# EasyEDA Pro project AgOopenHardwareMicro.eprj, schematic AiO v4 Micro
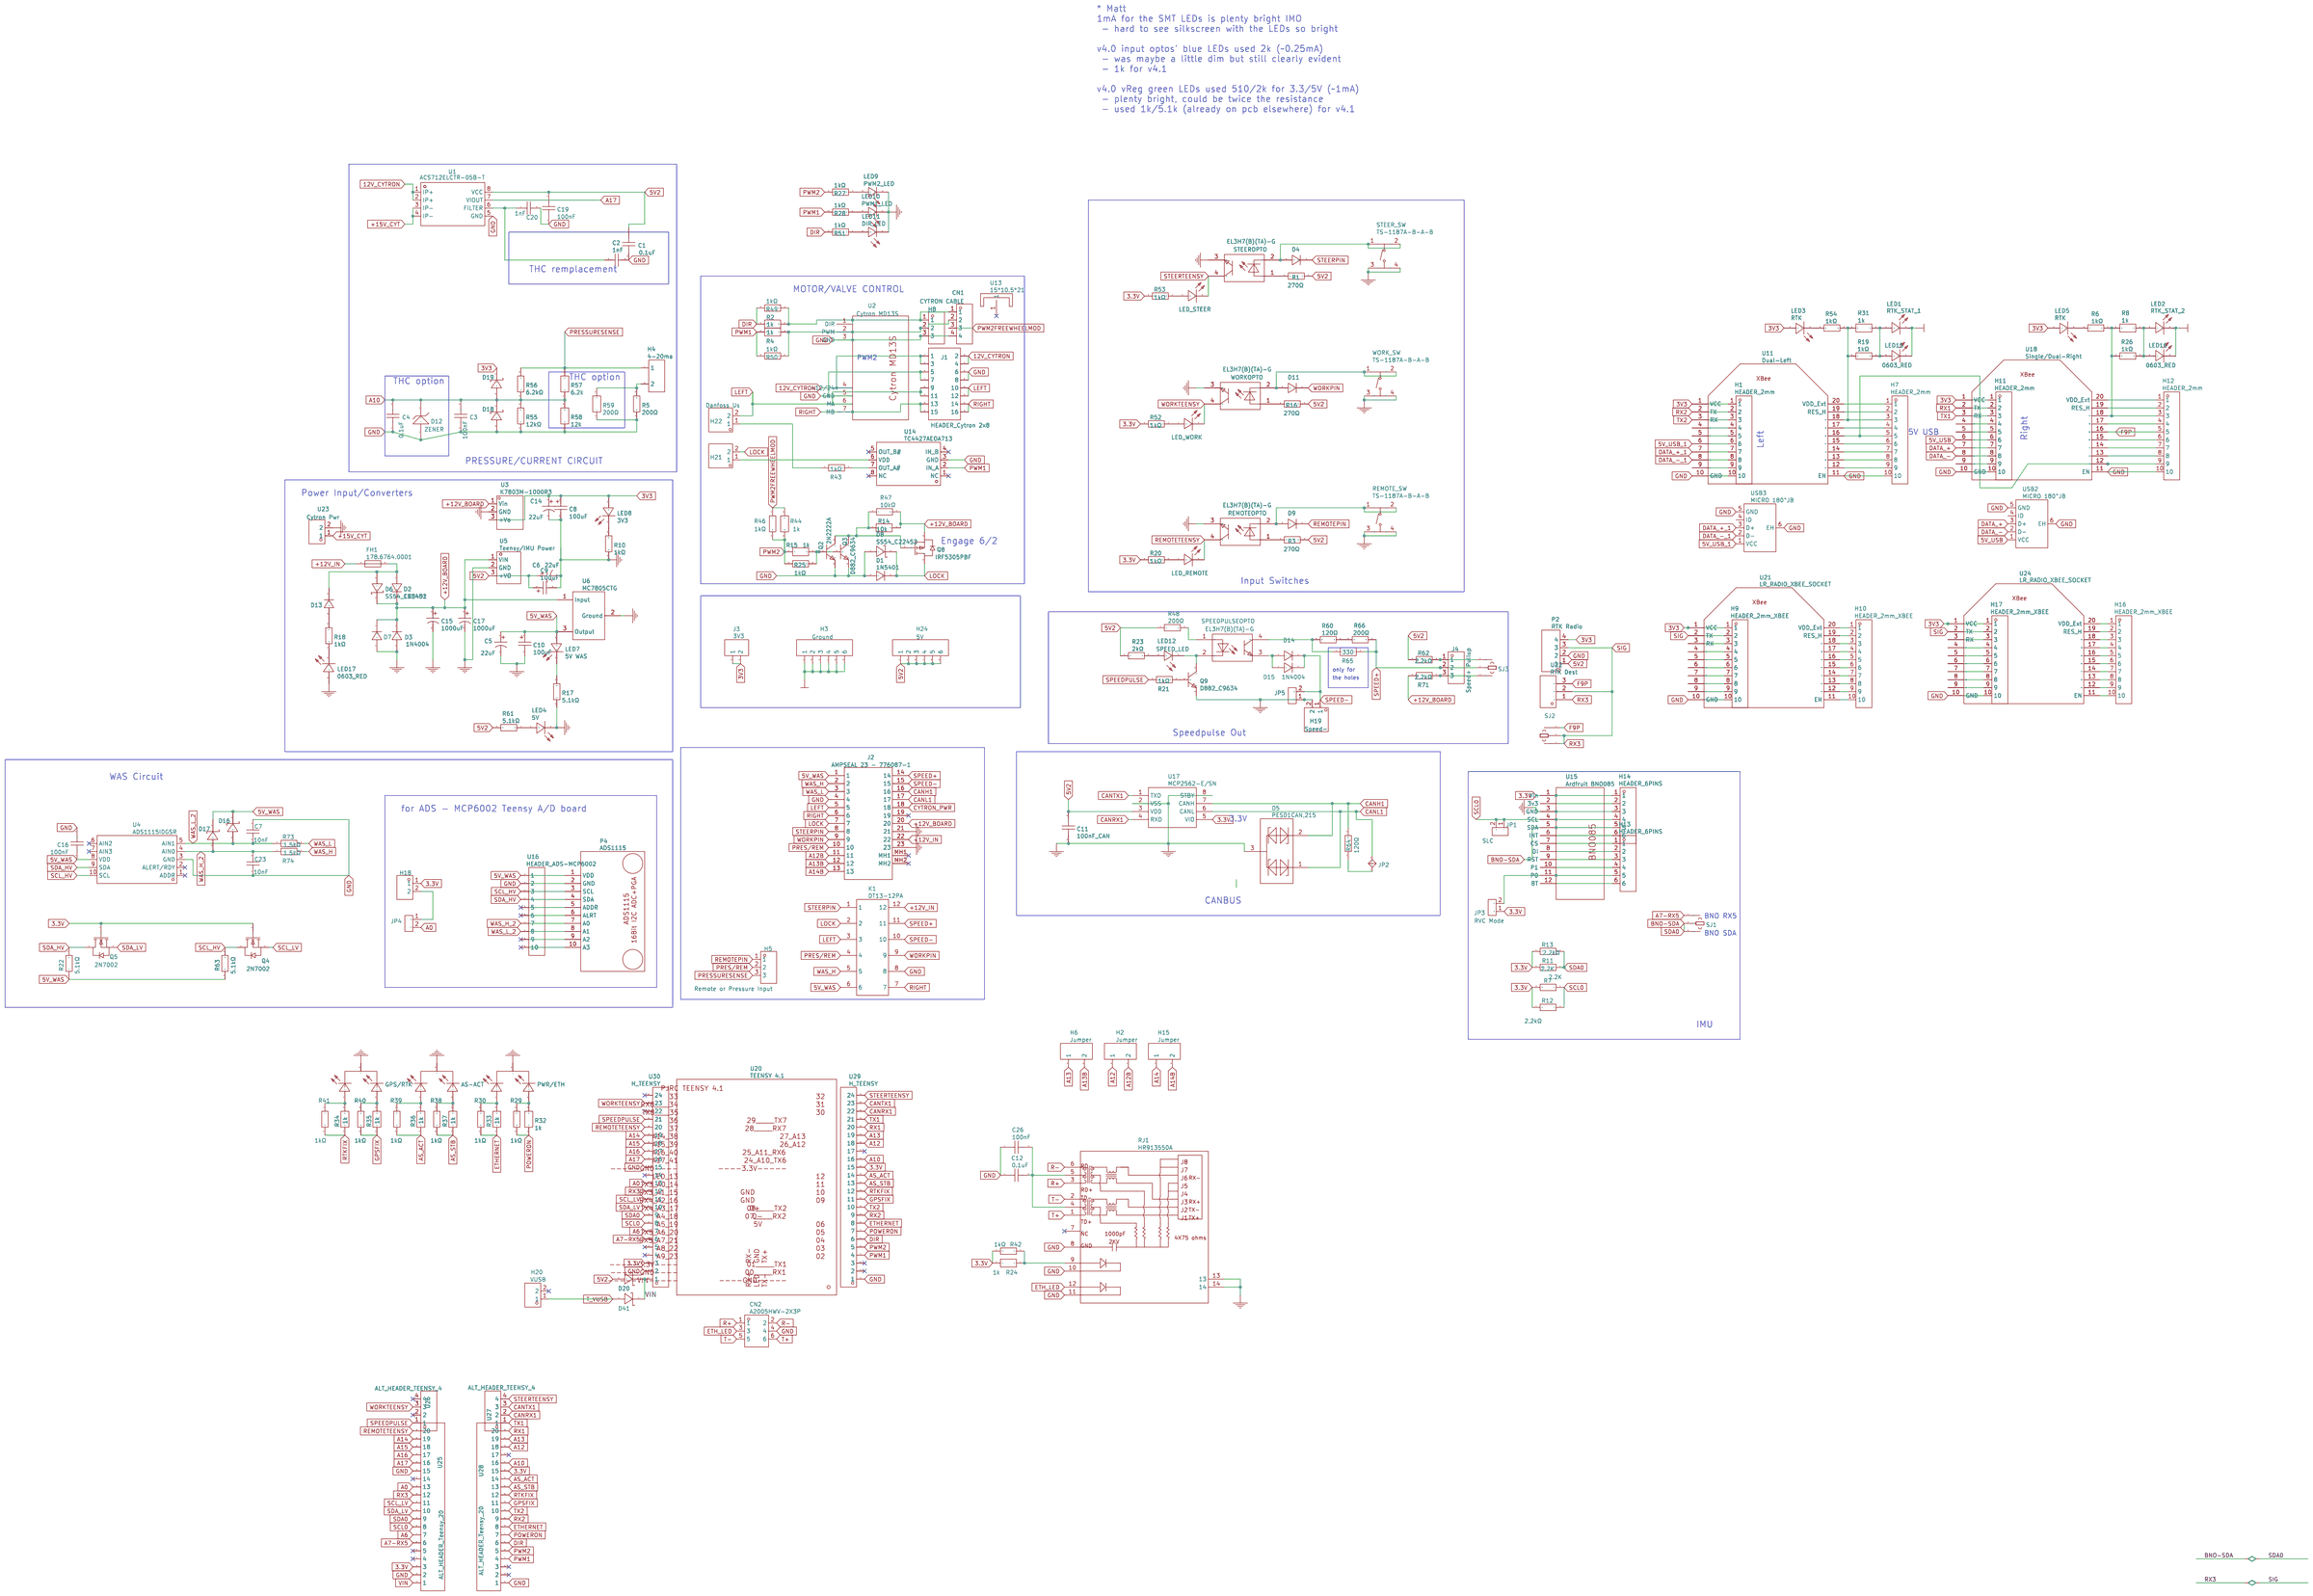
[diagram p0: schematic sheet]

## Parts
AS-ACT  DY-339URUYGW/SN  [footprint_04ce]
C1  0.1uF  [footprint_9b0b]  (no BOM)
C2  1nF  [footprint_89b2]  (no BOM)
C3  100nF  [footprint_19ac]
C4  0.1uF  [footprint_9b0b]  (no BOM)
C5  22uF  [footprint_a80e]  (no BOM)
C6  22uF  [footprint_a80e]  (no BOM)
C7  10nF  [footprint_89fb]
C8  100uF  [footprint_7bcb]
C9  100uF  [footprint_7bcb]
C10  100uF  [footprint_7bcb]
C11  100nF_CAN  [footprint_19ac]
C12  0.1uF  [footprint_9b0b]  (no BOM)
C14  22uF  [footprint_a80e]  (no BOM)
C15  1000uF  [footprint_6613]
C16  100nF  [footprint_19ac]
C17  1000uF  [footprint_6613]
C19  100nF  [footprint_19ac]
C20  1nF  [footprint_19ac]
C23  10nF  [footprint_89fb]
C26  100nF  [footprint_19ac]
CN1  CYTRON CABLE  [footprint_3aea]  (no BOM)
CN2  A2005HWV-2X3P  [footprint_9724]
D1  1N5401  [footprint_8dbb]  (no BOM)
D2  1N5401  [footprint_8dbb]  (no BOM)
D3  1N4004  [footprint_00b7]  (no BOM)
D4  SM4007PL  [footprint_5765]
D5  PESD1CAN,215  [footprint_eecc]
D6  SS54_C22452  [footprint_14cd]
D7  SM4007PL  [footprint_5765]
D8  SS54_C22452  [footprint_14cd]
D9  SM4007PL  [footprint_5765]
D11  SM4007PL  [footprint_5765]
D12  ZENER  [footprint_46d5]  (no BOM)
D13  SM4007PL  [footprint_5765]
D14  SM4007PL  [footprint_5765]
D15  1N4004  [footprint_00b7]  (no BOM)
D16  1N5819WS  [footprint_5a89]
D17  1N5819WS  [footprint_5a89]
D18  1N5819WS  [footprint_5a89]
D19  1N5819WS  [footprint_5a89]
D20  1N5819WS  [footprint_5976]
D41  1N5819WS  [footprint_5976]
FH1  178.6764.0001  [footprint_57e4]
GPS/RTK  DY-339URUYGW/SN  [footprint_04ce]
H1  HEADER_2mm  [footprint_0abc]
H2  Jumper  [footprint_61f6]  (no BOM)
H3  Ground  [footprint_dfc0]  (no BOM)
H4  4-20ma  [footprint_61f6]
H5  Remote or Pressure Input  [footprint_1175]
H6  Jumper  [footprint_61f6]  (no BOM)
H7  HEADER_2mm  [footprint_0abc]
H8  HEADER_3PINS  [footprint_1b4c]
H9  HEADER_2mm_XBEE  [footprint_0abc]
H10  HEADER_2mm_XBEE  [footprint_0abc]
H11  HEADER_2mm  [footprint_0abc]
H12  HEADER_2mm  [footprint_0abc]
H13  HEADER_6PINS  [footprint_c888]
H14  HEADER_6PINS  [footprint_c888]
H15  Jumper  [footprint_61f6]  (no BOM)
H16  HEADER_2mm_XBEE  (no BOM)
H17  HEADER_2mm_XBEE  (no BOM)
H18  22850102ANG1SYA02  [footprint_2104]
H19  Speed-  [footprint_61f6]
H20  VUSB  [footprint_6ba6]
H21  68000-102HLF  [footprint_61f6]
H22  Danfoss Us  [footprint_61f6]
H24  5V  [footprint_dfc0]  (no BOM)
J1  HEADER_Cytron 2x8  [footprint_5f34]
J2  AMPSEAL 23 - 776087-1  [footprint_1ad4]
J3  3V3  [footprint_4a10]  (no BOM)
J4  Speed+ Pullup  [footprint_1175]
JP1  SLC  [footprint_8437]  (no BOM)
JP2  SPARKFUN-JUMPERS_JUMPER-SMT_2_NC_PASTE_NO-SILK  [footprint_26ea]  (no BOM)
JP3  RVC Mode  [footprint_8437]  (no BOM)
JP4  A0  [footprint_8437]  (no BOM)
JP5  RVC Mode  [footprint_cc47]  (no BOM)
K1  DT13-12PA
LED1  RTK_STAT_1  [footprint_1af2]  (no BOM)
LED2  RTK_STAT_2  [footprint_1af2]  (no BOM)
LED3  RTK  [footprint_6589]
LED4  5V  [footprint_6589]
LED5  RTK  [footprint_6589]
LED7  5V WAS  [footprint_6589]
LED8  3V3  [footprint_6589]
LED9  PWM2_LED  [footprint_985f]
LED10  PWM1_LED  [footprint_985f]
LED11  DIR_LED  [footprint_985f]
LED12  SPEED_LED  [footprint_985f]
LED15  0603_RED  [footprint_985f]
LED16  0603_RED  [footprint_985f]
LED17  0603_RED  [footprint_985f]
LED_REMOTE  Remote  [footprint_6b63]
LED_STEER  Steer  [footprint_6b63]
LED_WORK  Work  [footprint_6b63]
P2  RTK Radio  [footprint_4317]  (no BOM)
P4  ADS1115  [footprint_5939]  (no BOM)
PWR/ETH  DY-339URUYGW/SN  [footprint_04ce]
Q2  2N2222A  [footprint_269b]  (no BOM)
Q3  D882_C9634  [footprint_89dc]
Q4  2N7002  [footprint_df55]
Q5  2N7002  [footprint_df55]
Q8  IRF5305PBF  [footprint_eaf4]
Q9  D882_C9634  [footprint_acbf]
R1  270Ω  [footprint_eb8a]
R2  1k  [footprint_b4b1]  (no BOM)
R3  270Ω  [footprint_eb8a]
R4  1k  [footprint_b4b1]  (no BOM)
R5  200Ω  [footprint_dc35]
R6  1kΩ  [footprint_4e14]
R7  2.2K  [footprint_a246]  (no BOM)
R8  1k  [footprint_b4b1]  (no BOM)
R10  1kΩ  [footprint_4e14]
R11  2.2K  [footprint_a246]  (no BOM)
R12  2.2kΩ  [footprint_dc35]
R13  2.2kΩ  [footprint_dc35]
R14  10k  [footprint_b4b1]  (no BOM)
R15  1k  [footprint_b4b1]  (no BOM)
R16  270Ω  [footprint_eb8a]
R17  5.1kΩ  [footprint_76e4]
R18  1kΩ  [footprint_4e14]
R19  1kΩ  [footprint_4e14]
R20  1kΩ  [footprint_4e14]
R21  1kΩ  [footprint_4e14]
R22  5.1kΩ  [footprint_76e4]
R23  2kΩ  [footprint_4e14]
R24  1k  [footprint_b4b1]  (no BOM)
R25  1kΩ  [footprint_4e14]
R26  1kΩ  [footprint_4e14]
R27  1kΩ  [footprint_4e14]
R28  1kΩ  [footprint_4e14]
R29  1kΩ  [footprint_4e14]
R30  1kΩ  [footprint_4e14]
R31  1k  [footprint_b4b1]  (no BOM)
R32  1k  [footprint_b4b1]  (no BOM)
R33  1k  [footprint_b4b1]  (no BOM)
R34  1k  [footprint_b4b1]  (no BOM)
R35  1k  [footprint_b4b1]  (no BOM)
R36  1k  [footprint_b4b1]  (no BOM)
R37  1k  [footprint_b4b1]  (no BOM)
R38  1kΩ  [footprint_4e14]
R39  1kΩ  [footprint_4e14]
R40  1kΩ  [footprint_4e14]
R41  1kΩ  [footprint_4e14]
R42  1kΩ  [footprint_4e14]
R43  1kΩ  [footprint_e2a5]
R44  1k  [footprint_b4b1]  (no BOM)
R46  1kΩ  [footprint_4e14]
R47  10kΩ  [footprint_e2a5]
R48  200Ω  [footprint_dc35]
R49  1kΩ  [footprint_4e14]
R50  1kΩ  [footprint_4e14]
R51  1kΩ  [footprint_4e14]
R52  1kΩ  [footprint_4e14]
R53  1kΩ  [footprint_4e14]
R54  1kΩ  [footprint_4e14]
R55  12kΩ  [footprint_4e14]
R56  6.2kΩ  [footprint_4e14]
R57  6.2k  [footprint_b4b1]  (no BOM)
R58  12k  [footprint_b4b1]  (no BOM)
R59  200Ω  [footprint_b4b1]  (no BOM)
R60  120Ω  [footprint_dc35]
R61  5.1kΩ  [footprint_76e4]
R62  2.2kΩ  [footprint_dc35]
R63  5.1kΩ  [footprint_76e4]
R64  120Ω  [footprint_dc35]
R65  330  [footprint_b4b1]  (no BOM)
R66  200Ω  [footprint_dc35]
R71  2.2kΩ  [footprint_dc35]
R73  1.5kΩ  [footprint_76e4]
R74  1.5kΩ  [footprint_76e4]
REMOTE_SW  TS-1187A-B-A-B  [footprint_86d5]
REMOTEOPTO  EL3H7(B)(TA)-G  [footprint_7a44]
RJ1  HR913550A  [footprint_28a5]
SJ1  JUMPER-PAD-3-NO  [footprint_9d65]  (no BOM)
SJ2  JUMPER-PAD-3-NO  [footprint_9d65]  (no BOM)
SJ3  JUMPER-PAD-3-NO  [footprint_e36f]  (no BOM)
SPEEDPULSEOPTO  EL3H7(B)(TA)-G  [footprint_7a44]
STEER_SW  TS-1187A-B-A-B  [footprint_86d5]
STEEROPTO  EL3H7(B)(TA)-G  [footprint_7a44]
U1  ACS712ELCTR-05B-T  [footprint_ae0f]
U2  Cytron MD13S  [footprint_8577]  (no BOM)
U3  K7803M-1000R3  [footprint_a0e4]
U4  ADS1115IDGSR  [footprint_a15c]
U5  Teensy/IMU Power  [footprint_8be4]
U6  MC7805CTG  [footprint_f649]
U11  Dual-Left  [footprint_247a]  (no BOM)
U13  15*10.5*21  [footprint_eabb]
U14  TC4427AEOA713  [footprint_b85c]
U15  Ardfruit BNO085  [footprint_7c61]  (no BOM)
U16  HEADER_ADS-MCP6002  [footprint_5ace]
U17  MCP2562-E/SN  [footprint_ae0f]
U18  Single/Dual-Right  [footprint_3ab3]  (no BOM)
U20  TEENSY 4.1  [footprint_e0fd]  (no BOM)
U21  LR_RADIO_XBEE_SOCKET  (no BOM)
U22  RTK Dest  (no BOM)
U23  Cytron Pwr  [footprint_8b36]  (no BOM)
U24  LR_RADIO_XBEE_SOCKET  [footprint_2c55]  (no BOM)
U25  ALT_HEADER_Teensy_20  (no BOM)
U26  ALT_HEADER_TEENSY_4  (no BOM)
U27  ALT_HEADER_TEENSY_4  (no BOM)
U28  ALT_HEADER_Teensy_20  (no BOM)
U29  H_TEENSY  [footprint_5514]
U30  H_TEENSY  [footprint_5514]
USB2  MICRO 180°JB  [footprint_5333]
USB3  MICRO 180°JB  [footprint_5333]
WORK_SW  TS-1187A-B-A-B  [footprint_86d5]
WORKOPTO  EL3H7(B)(TA)-G  [footprint_7a44]

## Library data of the parts
AS-ACT GPS/RTK PWR/ETH = DY-339URUYGW/SN: Supplier: LCSC; Supplier Part: C459134; Manufacturer: TONYU; JLCPCB Part Class: Extended Part
C1 C4 C12 = 0.1uF: Supplier: LCSC; Supplier Part: C444736; Manufacturer: AVX; Manufacturer Part: SR155C103KAR; JLCPCB Part Class: Extend
C2 = 1nF: Supplier: LCSC; Manufacturer: TDK; Manufacturer Part: CK45-B3AD102KYNNA; Supplier Part: C97720; JLCPCB Part Class: Extended Part
C3 C16 C19 C26 = 100nF: Supplier: LCSC; Manufacturer: YAGEO; Manufacturer Part: CC0603KRX7R9BB104; Supplier Part: C14663; JLCPCB Part Class: Basic Part
C5 C6 = 22uF: Supplier: LCSC; Manufacturer: ValuePro; Manufacturer Part: 22uF 16V 4*7; Supplier Part: C43845; JLCPCB Part Class: Extended Part
C7 C23 = 10nF: Supplier: LCSC; Manufacturer Part: CL21B103KBANNNC; Manufacturer: SAMSUNG; Supplier Part: C1710; JLCPCB Part Class: Basic Part
C8-C10 = 100uF: Supplier: LCSC; Manufacturer: Kyocera AVX; Manufacturer Part: TAJB107K006RNJ; Supplier Part: C16133; JLCPCB Part Class: Basic Part
C11 = 100nF_CAN: Supplier: LCSC; Manufacturer: YAGEO; Manufacturer Part: CC0603KRX7R9BB104; Supplier Part: C14663; JLCPCB Part Class: Basic Part
C14 = 22uF: Supplier: LCSC; Manufacturer: ValuePro; Manufacturer Part: 22uF 16V 4*5; Supplier Part: C43800; JLCPCB Part Class: Extended Part
C15 C17 = 1000uF: Supplier: LCSC; Manufacturer: rubycon(红宝石); Manufacturer Part: 35YXJ1000M12.5X20; Supplier Part: C88743; JLCPCB Part Class: Extended Part
C20 = 1nF: Supplier: LCSC; Manufacturer Part: CL10B102KB8NNNC; Manufacturer: SAMSUNG; Supplier Part: C1588; JLCPCB Part Class: Basic Part
CN1 = CYTRON CABLE: Supplier: LCSC; Supplier Part: C403774; Manufacturer: Seeed(矽递科技); Manufacturer Part: SEEED-110990030; JLCPCB Part Class: Extended Part
CN2 = A2005HWV-2X3P: Supplier: LCSC; Supplier Part: C2906071; JLCPCB Part Class: Extended Part
D1 D2 = 1N5401: Supplier: LCSC; Manufacturer: MDD; image: //image.lceda.cn/szlcsc/C2459.jpg; Supplier Part: C2459; JLCPCB Part Class: Extend
D3 D15 = 1N4004: Supplier: LCSC; Manufacturer: MDD; image: //image.lceda.cn/szlcsc/C3058.jpg; Supplier Part: C3058; JLCPCB Part Class: Extend
D4 D7 D9 D11 D13 D14 = SM4007PL: Supplier: LCSC; Manufacturer: MDD; Supplier Part: C64898; JLCPCB Part Class: Basic Part; link: https://lcsc.com/eda_search?q=C64898&amp;%26type=1&amp;ref=editor
D5 = PESD1CAN,215: Supplier: LCSC; Manufacturer: Nexperia; image: //image.lceda.cn/szlcsc/C15771.jpg; Supplier Part: C15771; JLCPCB Part Class: Extend; JLCPCB SMD: Yes; Paste Type: expand
D6 D8 = SS54_C22452: Supplier: LCSC; Manufacturer Part: SS54; Manufacturer: MDD; Supplier Part: C22452; JLCPCB Part Class: Basic Part
D12 = ZENER: Zener Diode
D16-D20 D41 = 1N5819WS: Supplier: LCSC; Supplier Part: C191023; Manufacturer: Hottech(合科泰); JLCPCB Part Class: Basic Part; link: https://lcsc.com/eda_search?q=C191023&amp;%26type=1&amp;ref=editor
FH1 = 178.6764.0001: Supplier: LCSC; Supplier Part: C142933; Manufacturer: Littelfuse(美国力特); JLCPCB Part Class: Extended Part
H1 H7 H11 H12 = HEADER_2mm: Supplier: LCSC; Supplier Part: C691436; Manufacturer: BOOMELE(Boom Precision Elec); Manufacturer Part: C691436; JLCPCB Part Class: Extended Part
H2 H6 H15 = Jumper: Supplier: LCSC; Supplier Part: C2905434; JLCPCB Part Class: Extended Part
H3 = Ground: Supplier: LCSC; Manufacturer: BOOMELE; Manufacturer Part: Header-Male-2.54_1x6; Supplier Part: C37208; JLCPCB Part Class: Extended Part
H4 = 4-20ma: Supplier: LCSC; Supplier Part: C2905434; JLCPCB Part Class: Extended Part
H5 = Remote or Pressure Input: Supplier: LCSC; Supplier Part: C2937625; Manufacturer: XFCN(兴飞); Manufacturer Part: PZ254V-11-03P; JLCPCB Part Class: Extended Part; link: https://lcsc.com/eda_search?q=C2937625&amp;%26type=1&amp;ref=editor
H8 = HEADER_3PINS: Supplier: LCSC; Supplier Part: C146243; JLCPCB Part Class: Extended Part
H9 H10 H16 H17 = HEADER_2mm_XBEE: Supplier: LCSC; Supplier Part: C691436; Manufacturer: BOOMELE(Boom Precision Elec); Manufacturer Part: C691436; JLCPCB Part Class: Extended Part
H13 H14 = HEADER_6PINS: Supplier: LCSC; Supplier Part: C2897369; Manufacturer: HCTL(华灿天禄); Manufacturer Part: PM254-1-06-Z-8.5; JLCPCB Part Class: Extended Part
H18 = 22850102ANG1SYA02: Supplier: LCSC; Supplier Part: C429966; Manufacturer: JILN(锦凌); JLCPCB Part Class: Extended Part
H19 = Speed-: Supplier: LCSC; Supplier Part: C2905434; JLCPCB Part Class: Extended Part
H20 = VUSB: Supplier: LCSC; Supplier Part: C7499322; Manufacturer: Megastar(兆星); Manufacturer Part: ZX-PM2.54-1-2PY; JLCPCB Part Class: Extended Part
H21 = 68000-102HLF: Supplier: LCSC; Supplier Part: C2905434; JLCPCB Part Class: Extended Part
H22 = Danfoss Us: Supplier: LCSC; Supplier Part: C2905434; JLCPCB Part Class: Extended Part
H24 = 5V: Supplier: LCSC; Manufacturer: BOOMELE; Manufacturer Part: Header-Male-2.54_1x6; Supplier Part: C37208; JLCPCB Part Class: Extended Part
J1 = HEADER_Cytron 2x8: Supplier: LCSC; Manufacturer: BOOMELE(博穆精密); Manufacturer Part: 2.54-2*8P母; Supplier Part: C30734; JLCPCB Part Class: Extended Part
J2 = AMPSEAL 23 - 776087-1: Code RS: 718-1471; Ref Fabricant: 776087-1; Marque: TE Connectivity; Supplier Part: C378893; Link: https://fr.rs-online.com/web/p/embases-circuits-imprimes/7181471
J3 = 3V3: Supplier Part: C124375; Supplier: LCSC
J4 = Speed+ Pullup: Supplier: LCSC; Supplier Part: C2937625; Manufacturer: XFCN(兴飞); Manufacturer Part: PZ254V-11-03P; JLCPCB Part Class: Extended Part; link: https://lcsc.com/eda_search?q=C2937625&amp;%26type=1&amp;ref=editor
JP1 = SLC: Jumper 2 Pin
JP2 = SPARKFUN-JUMPERS_JUMPER-SMT_2_NC_PASTE_NO-SILK: Supplier: opencircuit
JP3 JP5 = RVC Mode: Jumper 2 Pin
JP4 = A0: Jumper 2 Pin
K1 = DT13-12PA: Manufacturer: DEUTSCH DT; link: https://www.te.com/usa-en/product-DT13-12PA.html?fbclid=IwAR39tNBAoYJf2IA76Wg8xnUmEBiRwHUhbK_2fx16O6vP97envFwLxjVRyOc
LED1 = RTK_STAT_1: Supplier: LCSC; Manufacturer: KENTO; Manufacturer Part: LEDOrange orange 3AO4UD; image: //image.lceda.cn/szlcsc/C62095.jpg; Supplier Part: C62095
LED2 = RTK_STAT_2: Supplier: LCSC; Manufacturer: KENTO; Manufacturer Part: LEDOrange orange 3AO4UD; image: //image.lceda.cn/szlcsc/C62095.jpg; Supplier Part: C62095
LED3 LED5 = RTK: Supplier: LCSC; Manufacturer: KENTO; Manufacturer Part: KT-0805翠绿; Supplier Part: C2297; JLCPCB Part Class: Basic Part
LED4 = 5V: Supplier: LCSC; Manufacturer: KENTO; Manufacturer Part: KT-0805翠绿; Supplier Part: C2297; JLCPCB Part Class: Basic Part
LED7 = 5V WAS: Supplier: LCSC; Manufacturer: KENTO; Manufacturer Part: KT-0805翠绿; Supplier Part: C2297; JLCPCB Part Class: Basic Part
LED8 = 3V3: Supplier: LCSC; Manufacturer: KENTO; Manufacturer Part: KT-0805翠绿; Supplier Part: C2297; JLCPCB Part Class: Basic Part
LED9 = PWM2_LED: Supplier: LCSC; Manufacturer: EVERLIGHT(亿光); Manufacturer Part: 19-213/Y2C-CQ2R2L/3T(CY); Supplier Part: C72038; JLCPCB Part Class: Basic Part
LED10 = PWM1_LED: Supplier: LCSC; Manufacturer: EVERLIGHT(亿光); Manufacturer Part: 19-213/Y2C-CQ2R2L/3T(CY); Supplier Part: C72038; JLCPCB Part Class: Basic Part
LED11 = DIR_LED: Supplier: LCSC; Manufacturer: EVERLIGHT(亿光); Manufacturer Part: 19-213/Y2C-CQ2R2L/3T(CY); Supplier Part: C72038; JLCPCB Part Class: Basic Part
LED12 = SPEED_LED: Supplier: LCSC; Manufacturer: EVERLIGHT(亿光); Manufacturer Part: 19-213/Y2C-CQ2R2L/3T(CY); Supplier Part: C72038; JLCPCB Part Class: Basic Part
LED15-LED17 = 0603_RED: Supplier: LCSC; Manufacturer: null; Manufacturer Part: KT-0603R; Supplier Part: C2286; JLCPCB Part Class: Basic Part
LED_REMOTE = Remote: Supplier: LCSC; Manufacturer: null; Manufacturer Part: KT-0603白灯; Supplier Part: C2290; JLCPCB Part Class: Basic Part
LED_STEER = Steer: Supplier: LCSC; Manufacturer: null; Manufacturer Part: KT-0603白灯; Supplier Part: C2290; JLCPCB Part Class: Basic Part
LED_WORK = Work: Supplier: LCSC; Manufacturer: null; Manufacturer Part: KT-0603白灯; Supplier Part: C2290; JLCPCB Part Class: Basic Part
P2 = RTK Radio: Supplier Part: C27542; Supplier: LCSC; Manufacturer: ReliaPro; Manufacturer Part: KF2510-4A; JLCPCB Part Class: Extended Part
P4 = ADS1115
Q2 = 2N2222A: Supplier: LCSC; Supplier Part: C358533; Manufacturer: Foshan Blue Rocket Elec; Paste Type: expand
Q3 Q9 = D882_C9634: Supplier: LCSC; Manufacturer: CJ(江苏长电/长晶); Manufacturer Part: D882 Y档160~320; Supplier Part: C9634; JLCPCB Part Class: Basic Part; link: https://lcsc.com/eda_search?q=C9634&amp;%26type=1&amp;ref=editor
Q4 Q5 = 2N7002: Supplier: LCSC; Manufacturer: CJ; Supplier Part: C8545; JLCPCB Part Class: Basic Part
Q8 = IRF5305PBF: Supplier: LCSC; Manufacturer: Infineon(英飞凌); Supplier Part: C2623; JLCPCB Part Class: Extended Part
R1 R3 R16 = 270Ω: Supplier: LCSC; Manufacturer: UNI-ROYAL(厚声); Manufacturer Part: 0603WAF2700T5E; Supplier Part: C22966; Resistance: 270; JLCPCB Part Class: Basic Part
R2 R4 R8 R15 R24 R31-R37 R44 = 1k: Supplier: LCSC; Supplier Part: C433798; Manufacturer: TyoHM; Manufacturer Part: RD 1/2WS 1K J T/B A1
R5 R48 R66 = 200Ω: Supplier: LCSC; Manufacturer: UNI-ROYAL(厚声); Manufacturer Part: 0805W8F2000T5E; Supplier Part: C17540; Resistance: 200; JLCPCB Part Class: Basic Part
R6 R10 R18-R21 R25-R30 R38-R42 R46 R49-R54 = 1kΩ: Supplier: LCSC; Manufacturer: UNI-ROYAL(厚声); Manufacturer Part: 0603WAF1001T5E; Supplier Part: C21190; JLCPCB Part Class: Basic Part; link: https://lcsc.com/eda_search?q=C21190&amp;%26type=1&amp;ref=editor
R7 R11 = 2.2K: Supplier: LCSC; Manufacturer: UniOhm; Manufacturer Part: MFR0W4F2201A50; Supplier Part: C58595; JLCPCB Part Class: Extended Part; Resistance: 2.2kΩ
R12 R13 R62 R71 = 2.2kΩ: Supplier: LCSC; Manufacturer: UniOhm; Manufacturer Part: 0805W8F2201T5E; Supplier Part: C17520; Resistance: 2.2K; JLCPCB Part Class: Basic Part
R14 = 10k: Supplier: LCSC; Supplier Part: C433798; Manufacturer: TyoHM; Manufacturer Part: RD 1/2WS 1K J T/B A1
R17 R22 R61 R63 = 5.1kΩ: Supplier: LCSC; Manufacturer Part: 0603WAF5101T5E; Manufacturer: UniOhm; Supplier Part: C23186; Resistance: 5.1K; JLCPCB Part Class: Basic Part
R23 = 2kΩ: Supplier: LCSC; Manufacturer: UNI-ROYAL(厚声); Manufacturer Part: 0603WAF2001T5E; Supplier Part: C22975; JLCPCB Part Class: Basic Part; link: https://lcsc.com/eda_search?q=C22975&amp;%26type=1&amp;ref=editor
R43 = 1kΩ: Supplier: LCSC; Manufacturer: UNI-ROYAL(厚声); Manufacturer Part: 1206W4F1001T5E; Supplier Part: C4410; JLCPCB Part Class: Basic Part
R47 = 10kΩ: Supplier: LCSC; Manufacturer: UniOhm; Manufacturer Part: 1206W4F1002T5E; Supplier Part: C17902; Resistance: 10K; JLCPCB Part Class: Basic Part
R55 = 12kΩ: Supplier: LCSC; Manufacturer: UNI-ROYAL(厚声); Manufacturer Part: 0603WAF1202T5E; Supplier Part: C22790; JLCPCB Part Class: Basic Part; link: https://lcsc.com/eda_search?q=C22790&amp;%26type=1&amp;ref=editor
R56 = 6.2kΩ: Supplier: LCSC; Manufacturer: UNI-ROYAL(厚声); Manufacturer Part: 0603WAF6201T5E; Supplier Part: C4260; JLCPCB Part Class: Basic Part; link: https://lcsc.com/eda_search?q=C4260&amp;%26type=1&amp;ref=editor
R57 = 6.2k: Supplier: LCSC; Manufacturer: TyoHM; Manufacturer Part: RD 1/2WS 1K J T/B A1
R58 = 12k: Supplier: LCSC
R59 = 200Ω: Supplier: LCSC
R60 R64 = 120Ω: Supplier: LCSC; Manufacturer: UniOhm; Manufacturer Part: 0805W8F1200T5E; Supplier Part: C17437; Resistance: 120; JLCPCB Part Class: Basic Part
R65 = 330: Supplier: LCSC; Manufacturer: TyoHM; Manufacturer Part: RD 1/2WS 1K J T/B A1
R73 R74 = 1.5kΩ: Supplier: LCSC; Manufacturer: UniOhm; Manufacturer Part: 0603WAF1501T5E; Supplier Part: C22843; Resistance: 1.5K; JLCPCB Part Class: Basic Part
REMOTE_SW STEER_SW WORK_SW = TS-1187A-B-A-B: Supplier: LCSC; Supplier Part: C318884; Manufacturer: XKB Connectivity(中国星坤); JLCPCB Part Class: Basic Part
REMOTEOPTO SPEEDPULSEOPTO STEEROPTO WORKOPTO = EL3H7(B)(TA)-G: Supplier: LCSC; Manufacturer: EVERLIGHT(亿光); Supplier Part: C32565; JLCPCB Part Class: Basic Part
RJ1 = HR913550A: Supplier: LCSC; Manufacturer: HANRUN; Supplier Part: C163507; JLCPCB Part Class: Extended Part
SJ1-SJ3 = JUMPER-PAD-3-NO
U1 = ACS712ELCTR-05B-T: Supplier: LCSC; Manufacturer: ALLEGRO(美国埃戈罗); Supplier Part: C44471; JLCPCB Part Class: Extended Part
U2 = Cytron MD13S
U3 = K7803M-1000R3: Supplier: LCSC; Manufacturer: MORNSUN(金升阳); Supplier Part: C132363; JLCPCB Part Class: Extended Part
U4 = ADS1115IDGSR: Supplier: LCSC; Manufacturer: TI; Supplier Part: C37593; JLCPCB Part Class: Extended Part
U5 = Teensy/IMU Power: Supplier: LCSC; Manufacturer: MORNSUN; Manufacturer Part: K7805M-1000R3; Supplier Part: C132362; JLCPCB Part Class: Extended Part
U6 = MC7805CTG: Supplier: LCSC; Manufacturer: ON; Supplier Part: C22456; JLCPCB Part Class: Extended Part
U11 = Dual-Left: Supplier: Ardusimple
U13 = 15*10.5*21: Supplier: LCSC; Supplier Part: C4649; Manufacturer: Made in China; JLCPCB Part Class: Extended Part
U14 = TC4427AEOA713: Supplier: LCSC; Manufacturer: MICROCHIP(美国微芯); Supplier Part: C20551; JLCPCB Part Class: Extended Part
U15 = Ardfruit BNO085: Manufacturer: Ardfruit
U16 = HEADER_ADS-MCP6002: Supplier Part: C2897373; Supplier: LCSC
U17 = MCP2562-E/SN: Supplier: LCSC; Manufacturer: MICROCHIP; Supplier Part: C53609; JLCPCB Part Class: Extended Part
U18 = Single/Dual-Right: Supplier: Ardusimple
U20 = TEENSY 4.1: Manufacturer: PJRC; Manufacturer Part: TEENSY41; Supplier: PJRC; Supplier Part: TEENSY41; link: https://www.pjrc.com/store/teensy41.html
U21 U24 = LR_RADIO_XBEE_SOCKET
U22 = RTK Dest: Supplier: LCSC; Supplier Part: C49257; JLCPCB Part Class: Extended Part
U23 = Cytron Pwr: Supplier: LCSC; Supplier Part: C387820; Manufacturer: JILN; Manufacturer Part: JL500-50802G01; JLCPCB Part Class: Extended Part
U25 U28 = ALT_HEADER_Teensy_20: Supplier: LCSC; Manufacturer: BOOMELE; Manufacturer Part: 2.54mm 1*20P Female header; Supplier Part: C50984; JLCPCB Part Class: Extended Part
U26 U27 = ALT_HEADER_TEENSY_4: Supplier: LCSC; Supplier Part: C2685089; Manufacturer: Liansheng(连盛); Manufacturer Part: FH-00133; JLCPCB Part Class: Extended Part
U29 U30 = H_TEENSY: Supplier: LCSC; Supplier Part: C2883741; Manufacturer: XKB Connectivity(中国星坤); Manufacturer Part: X6511FV-24-C85D32; JLCPCB Part Class: Extended Part
USB2 USB3 = MICRO 180°JB: Supplier: LCSC; Supplier Part: C456007; Manufacturer: SHOU HAN(首韩); JLCPCB Part Class: Extended Part

## Nets
3.3V: H14.1 H18.1 JP3.1 Q4.1(G) Q5.1(G) R7.2 R11.2 R12.1 R13.1 R20.2 R24.2 R42.2 R52.2 R53.2 U15.1(Vin) U17.5(VIO) U25.3 U28.15 U29.15 U30.3
3V3: C8.1 C14.1 D19.1(K) H1.1 H9.1 H11.1 H17.1 J3.1 J3.2 LED3.1(A) LED5.1(A) LED8.1(A) P2.4 U3.3(+Vo) U11.1(VCC) U18.1(VCC) U21.1(VCC) U24.1(VCC)
5V2: C1.1 C6.1 C9.1 C11.2 C19.2 D20.2(A) H24.1 H24.2 H24.3 H24.4 H24.5 H24.6 P2.1 R1.2 R3.2 R16.2 R23.1 R48.1 R61.2 R62.1 U1.8(VCC) U5.3(+VO) U17.3(VDD)
5V_USB: H11.6 U18.6(PWM0RSSI) USB2.1(VCC)
5V_USB_1: H1.6 U11.6(PWM0RSSI) USB3.1(VCC)
5V_WAS: C5.1 C10.1 C16.1 D16.1(K) D17.1(K) J2.1 K1.6 LED7.1(A) P4.1(VDD) R22.1 R63.1 U4.8(VDD) U6.3(Output) U16.1
12V_CYTRON: J1.1 J1.2 J1.3 J1.4 U1.1(IP+) U1.2(IP+) U2.4(+12/24)
+12V_BOARD: C15.1 C17.1 D2.1(C) D3.2(K) D6.2(K) D7.1(C) J2.20 Q8.3(S) R14.2 R47.2 R71.1 U3.1(Vin) U5.1(VIN) U6.1(Input)
+12V_IN: FH1.1 J2.22 K1.12
+15V_CYT: U1.3(IP-) U1.4(IP-) U23.1
GND: AS-ACT.2(-) C1.2 C2.2 C3.1 C4.1 C5.2 C6.2 C7.2 C8.2 C9.2 C10.2 C11.1 C12.1 C14.2 C15.2 C16.2 C17.2 C19.1 C20.2 C23.1 C26.1 CN1.4 CN2.4 D1.2(A) D3.1(A) D5.3 D7.2(A) D8.1(A) D12.1(A) D18.2(A) GPS/RTK.2(-) H1.10 H3.1 H3.2 H3.3 H3.4 H3.5 H3.6 H7.10 H8.3 H9.10 H11.10 H12.10 H14.3 H17.10 H19.2 J1.5 J1.6 J1.7 J1.8 J2.4 J2.21 J2.23 JP5.1 K1.8 LED1.2(K) LED2.2(K) LED4.2(K) LED9.1(C) LED10.1(C) LED11.1(C) LED15.1(K) LED16.1(K) LED17.2(A) P2.2 P4.2(GND) PWR/ETH.2(-) Q2.3(E) Q3.3(E) Q9.3(E) R5.1 R10.1 R17.1 R55.1 R58.1 R59.1 REMOTE_SW.3(C) REMOTE_SW.4(D) REMOTEOPTO.3(EM) RJ1.8(GND) RJ1.10 RJ1.11 RJ1.13 RJ1.14 STEER_SW.3(C) STEER_SW.4(D) STEEROPTO.3(EM) U1.5(GND) U2.3(GND) U2.5(GND) U3.2(GND) U4.3(GND) U5.2(GND) U6.2(Ground) U11.10(GND) U11.11(EN) U14.3(GND) U15.3(GND) U16.2 U17.2(VSS) U17.8(STBY) U18.10(GND) U18.11(EN) U21.10(GND) U23.2 U24.10(GND) U25.2 U25.15 U28.1 U29.1 U30.2 U30.15 USB2.5(GND) USB2.6(EH) USB3.5(GND) USB3.6(EH) WORK_SW.3(C) WORK_SW.4(D) WORKOPTO.3(EM)
VIN: D20.1(K) D41.1(K) U25.1 U30.1
A0: JP4.2 U25.13 U30.13
A6: U25.7 U30.7
A7-RX5: SJ1.1 U25.6 U30.6
A10: C3.2 C4.2 D12.2(K) D18.1(K) D19.2(A) R55.2 R56.1 R57.1 R58.2 U28.16 U29.16
A12: H2.1 U28.18 U29.18
A12B: H2.2 J2.11
A13: H6.1 U28.19 U29.19
A13B: H6.2 J2.12
A14: H15.1 U25.19 U30.19
A14B: H15.2 J2.13
A15: U25.18 U30.18
A16: U25.17 U30.17
A17: U1.7(VIOUT) U25.16 U30.16
AS_ACT: R36.1 R39.2 U28.14 U29.14
AS_STB: R37.1 R38.2 U28.13 U29.13
BNO-SDA: H14.5 R11.1 R13.2 SJ1.2 SJ1.3 U15.5(SDA) U25.9 U30.9
CANH1: D5.2 J2.16 R64.2 U17.7(CANH)
CANL1: D5.1 J2.17 JP2.2 U17.6(CANL)
CANRX1: U17.4(RXD) U27.2 U29.22
CANTX1: U17.1(TXD) U27.3 U29.23
CYTRON_PWR: J2.18
DATA_+: H11.7 U18.7(PWM1) USB2.3(D+)
DATA_+_1: H1.7 U11.7(PWM1) USB3.3(D+)
DATA_-: H11.8 U18.8(RESERVED) USB2.2(D-)
DATA_-_1: H1.8 U11.8(RESERVED) USB3.2(D-)
DIR: R2.1 R49.2 R51.2 U28.6 U29.6
ETH_LED: CN2.3 RJ1.12
ETHERNET: R30.2 R33.1 U28.8 U29.8
F9P: H12.5 SJ2.3 U18.16(RTSAD6DIO6) U22.3
GPSFIX: R35.1 R40.2 U28.11 U29.11
LEFT: H22.2 J1.9 J1.10 J1.11 J1.12 J2.5 K1.3 U2.6(MA)
LOCK: D1.1(C) D8.2(K) H21.2 J2.7 K1.2 Q8.2(D)
POWERON: R29.2 R32.1 U28.7 U29.7
PRES/REM: H5.2 J2.10 K1.4
PRESSURESENSE: H4.1 H5.3 R56.2 R57.2
PWM1: R4.1 R28.2 R50.2 U14.2(IN A) U28.4 U29.4
PWM2: R15.1 R25.1 R27.2 R44.2 R46.2 U28.5 U29.5
PWM2FREEWHEELMOD: CN1.3 R44.1 R46.1
R+: CN2.1 RJ1.3
R-: CN2.2 RJ1.6
REMOTEPIN: D9.1(C) H5.1
REMOTETEENSY: LED_REMOTE.2(K) REMOTEOPTO.4(COL) U25.20 U30.20
RIGHT: J1.13 J1.14 J1.15 J1.16 J2.6 K1.7 U2.7(MB)
RTKFIX: R34.1 R41.2 U28.12 U29.12
RX1: H11.2 U18.2(TX) U28.20 U29.20
RX2: H1.2 U11.2(TX) U28.9 U29.9
RX3: H9.2 H17.2 P2.3 SJ2.1 SJ2.2 U21.2(TX) U22.1 U22.2 U24.2(TX) U25.12 U30.12
SCL0: H14.4 JP1.1 JP1.2 R7.1 R12.2 U15.4(SCL) U25.8 U30.8
SCL_HV: P4.3(SCL) Q4.3(D) R63.2 U4.10(SCL) U16.3
SCL_LV: Q4.2(S) U25.11 U30.11
SDA_HV: P4.4(SDA) Q5.3(D) R22.2 U4.9(SDA) U16.4
SDA_LV: Q5.2(S) U25.10 U30.10
SPEED+: J2.14 J4.2 K1.11 R65.2 R66.1 SJ3.2
SPEED-: D14.1(C) D15.2(K) H19.1 J2.15 JP5.2 K1.10
SPEEDPULSE: R21.2 U26.1 U30.21
STEERPIN: D4.1(C) J2.8 K1.1
STEERTEENSY: LED_STEER.2(K) STEEROPTO.4(COL) U27.4 U29.24
T+: CN2.6 RJ1.1
T-: CN2.5 RJ1.2
T_VUSB: D41.2(A) H20.1
TX1: H11.3 U18.3(RX) U27.1 U29.21
TX2: H1.3 U11.3(RX) U28.10 U29.10
WAS_H: J2.2 K1.5 R74.2
WAS_H_2: C23.2 D17.2(A) P4.7(A0) R74.1 U4.4(AIN0) U16.7
WAS_L: J2.3 R73.2
WAS_L_2: C7.1 D16.2(A) P4.8(A1) R73.1 U4.5(AIN1) U16.8
WORKPIN: D11.1(C) J2.9 K1.9
WORKTEENSY: LED_WORK.2(K) U26.3 U30.23 WORKOPTO.4(COL)
AS-ACT_1: AS-ACT.1(+) R36.2 R39.1
AS-ACT_3: AS-ACT.3(+) R37.2 R38.1
C2_1: C2.1 C20.1 U1.6(FILTER)
D2_2: D2.2(A) D6.1(A) D13.1(C) FH1.2
D4_2: D4.2(A) STEER_SW.1(A) STEER_SW.2(B) STEEROPTO.2(CAT)
D9_2: D9.2(A) REMOTE_SW.1(A) REMOTE_SW.2(B) REMOTEOPTO.2(CAT)
D11_2: D11.2(A) WORK_SW.1(A) WORK_SW.2(B) WORKOPTO.2(CAT)
D13_2: D13.2(A) R18.2
D15_1: D14.2(A) D15.1(A) SPEEDPULSEOPTO.3(EM)
GPS/RTK_1: GPS/RTK.1(+) R34.2 R41.1
GPS/RTK_3: GPS/RTK.3(+) R35.2 R40.1
H4_2: H4.2 R5.2 R59.2
H22_1: H22.1 R43.1
J4_1: J4.1 R62.2 SJ3.1
J4_3: J4.3 R71.2 SJ3.3
JP4_1: H18.2 JP4.1
LED2_1: LED2.1(A) LED16.2(A) R8.1 R26.1
LED9_2: LED9.2(A) R27.1
LED10_2: LED10.2(A) R28.1
LED11_2: LED11.2(A) R51.1
LED12_1: LED12.1(C) Q9.2(C) SPEEDPULSEOPTO.2(CAT)
LED12_2: LED12.2(A) R23.2
LED17_1: LED17.1(K) R18.1
LED_REMOTE_1: LED_REMOTE.1(A) R20.1
LED_STEER_1: LED_STEER.1(A) R53.1
LED_WORK_1: LED_WORK.1(A) R52.1
Net-(H1-4): H1.4 U11.4(DO8)
Net-(H1-5): H1.5 U11.5(RESET)
Net-(H1-9): H1.9 U11.9(DTRDI8)
Net-(H7-1): H7.1 U11.20(VDD_Ext)
Net-(H7-2): H7.2 U11.19(RES_H)
Net-(H7-4): H7.4 U11.17(AD3DIO3)
Net-(H7-6): H7.6 U11.15(ASCAD5DIO5)
Net-(H7-7): H7.7 U11.14(VREF)
Net-(H7-8): H7.8 U11.13(ONSLEEP)
Net-(H7-9): H7.9 U11.12(CTSDIO7)
Net-(H9-3): H9.3 U21.3(RX)
Net-(H9-4): H9.4 U21.4(DO8)
Net-(H9-5): H9.5 U21.5(RESET)
Net-(H9-6): H9.6 U21.6(PWM0RSSI)
Net-(H9-7): H9.7 U21.7(PWM1)
Net-(H9-8): H9.8 U21.8(RESERVED)
Net-(H9-9): H9.9 U21.9(DTRDI8)
Net-(H10-1): H10.1 U21.20(VDD_Ext)
Net-(H10-2): H10.2 U21.19(RES_H)
Net-(H10-3): H10.3 U21.18(AD2DIO2)
Net-(H10-4): H10.4 U21.17(AD3DIO3)
Net-(H10-5): H10.5 U21.16(RTSAD6DIO6)
Net-(H10-6): H10.6 U21.15(ASCAD5DIO5)
Net-(H10-7): H10.7 U21.14(VREF)
Net-(H10-8): H10.8 U21.13(ONSLEEP)
Net-(H10-9): H10.9 U21.12(CTSDIO7)
Net-(H10-10): H10.10 U21.11(EN)
Net-(H11-4): H11.4 U18.4(DO8)
Net-(H11-5): H11.5 U18.5(RESET)
Net-(H11-9): H11.9 U18.9(DTRDI8)
Net-(H12-1): H12.1 U18.20(VDD_Ext)
Net-(H12-2): H12.2 U18.19(RES_H)
Net-(H12-4): H12.4 U18.17(AD3DIO3)
Net-(H12-6): H12.6 U18.15(ASCAD5DIO5)
Net-(H12-7): H12.7 U18.14(VREF)
Net-(H12-8): H12.8 U18.13(ONSLEEP)
Net-(H16-1): H16.1 U24.20(VDD_Ext)
Net-(H16-2): H16.2 U24.19(RES_H)
Net-(H16-3): H16.3 U24.18(AD2DIO2)
Net-(H16-4): H16.4 U24.17(AD3DIO3)
Net-(H16-5): H16.5 U24.16(RTSAD6DIO6)
Net-(H16-6): H16.6 U24.15(ASCAD5DIO5)
Net-(H16-7): H16.7 U24.14(VREF)
Net-(H16-8): H16.8 U24.13(ONSLEEP)
Net-(H16-9): H16.9 U24.12(CTSDIO7)
Net-(H16-10): H16.10 U24.11(EN)
Net-(H17-3): H17.3 U24.3(RX)
Net-(H17-4): H17.4 U24.4(DO8)
Net-(H17-5): H17.5 U24.5(RESET)
Net-(H17-6): H17.6 U24.6(PWM0RSSI)
Net-(H17-7): H17.7 U24.7(PWM1)
Net-(H17-8): H17.8 U24.8(RESERVED)
Net-(H17-9): H17.9 U24.9(DTRDI8)
Net-(P4-5): P4.5(ADDR) U16.5
Net-(P4-6): P4.6(ALRT) U16.6
Net-(P4-9): P4.9(A2) U16.9
Net-(P4-10): P4.10(A3) U16.10
PWR/ETH_1: PWR/ETH.1(+) R30.1 R33.2
PWR/ETH_3: PWR/ETH.3(+) R29.1 R32.2
Q2_1: Q2.1(C) Q3.2(C) Q8.1(G) R14.1 R47.1
Q9_1: Q9.1(B) R21.1
R1_1: R1.1 STEEROPTO.1(AN)
R3_1: R3.1 REMOTEOPTO.1(AN)
R6_2: LED5.2(K) R6.2
R10_2: LED8.2(K) R10.2
R15_2: Q2.2(B) Q3.1(B) R15.2 R25.2
R16_1: R16.1 WORKOPTO.1(AN)
R17_2: LED7.2(K) R17.2
R31_1: LED1.1(A) LED15.2(A) R19.1 R31.1
R48_2: R48.2 SPEEDPULSEOPTO.1(AN)
R54_2: LED3.2(K) R54.2
R60_1: R60.1 R66.2
R60_2: R60.2 R65.1 SPEEDPULSEOPTO.4(COL)
R61_1: LED4.1(A) R61.1
R64_1: JP2.1 R64.1
RJ1_5: C12.2 C26.2 RJ1.4 RJ1.5
RJ1_9: R24.1 R42.1 RJ1.9
U2_1: CN1.1 H8.1 R2.2 R49.1 U2.1(DIR)
U2_2: CN1.2 H8.2 R4.2 R50.1 U2.2(PWM)
U11_16: H7.5 H12.9 U11.16(RTSAD6DIO6) U18.12(CTSDIO7)
U11_18: H7.3 R19.2 R31.2 R54.1 U11.18(AD2DIO2)
U14_6: H21.1 U14.6(VDD)
U14_7: R43.2 U14.7(OUT A#)
U15_2: H14.2 U15.2(3v3)
U15_6: H14.6 U15.6(INT)
U15_7: H13.1 U15.7(CS)
U15_8: H13.2 U15.8(DI)
U15_9: H13.3 U15.9(RST)
U15_10: H13.4 U15.10(P1)
U15_11: H13.5 JP3.2 U15.11(P0)
U15_12: H13.6 U15.12(BT)
U18_18: H12.3 R6.1 R8.2 R26.2 U18.18(AD2DIO2)

Not connected (* = marked no-connect by the designer): H20 2*; J2 19* MH1* MH2*; RJ1 7(NC)*; U4 1(ADDR)* 2(ALERT/RDY)* 6(AIN2)* 7(AIN3)*; U13 1*; U14 1(NC)* 4(IN B)* 5(OUT B#)* 8(NC)*; U25 4* 5* 14*; U26 2* 4*; U28 2* 3* 17*; U29 2* 3* 17*; U30 4* 5* 14* 22* 24*; USB2 4(ID); USB3 4(ID)

## Notes on the sheet
- * Matt
  1mA for the SMT LEDs is plenty bright IMO
   - hard to see silkscreen with the LEDs so bright
  v4.0 input optos' blue LEDs used 2k (~0.25mA)
   - was maybe a little dim but still clearly evident
   - 1k for v4.1
  v4.0 vReg green LEDs used 510/2k for 3.3/5V (~1mA)
   - plenty bright, could be twice the resistance
   - used 1k/5.1k (already on pcb elsewhere) for v4.1
- THC remplacement
- MOTOR/VALVE CONTROL
- PWM2
- THC option
- THC option
- 5V USB
- Right
- Left
- PRESSURE/CURRENT CIRCUIT
- Power Input/Converters
- Engage 6/2
- Input Switches
- only for
- the holes
- Speedpulse Out
- WAS Circuit
- for ADS - MCP6002 Teensy A/D board
- 3.3V
- CANBUS
- BNO RX5
- BNO SDA
- IMU
